# EasyEDA Pro project 第十五届蓝桥杯EDA赛项模拟试题二（嘉立创EDA提供）.eprj, board PCB-PockerMultimater1 (continued)
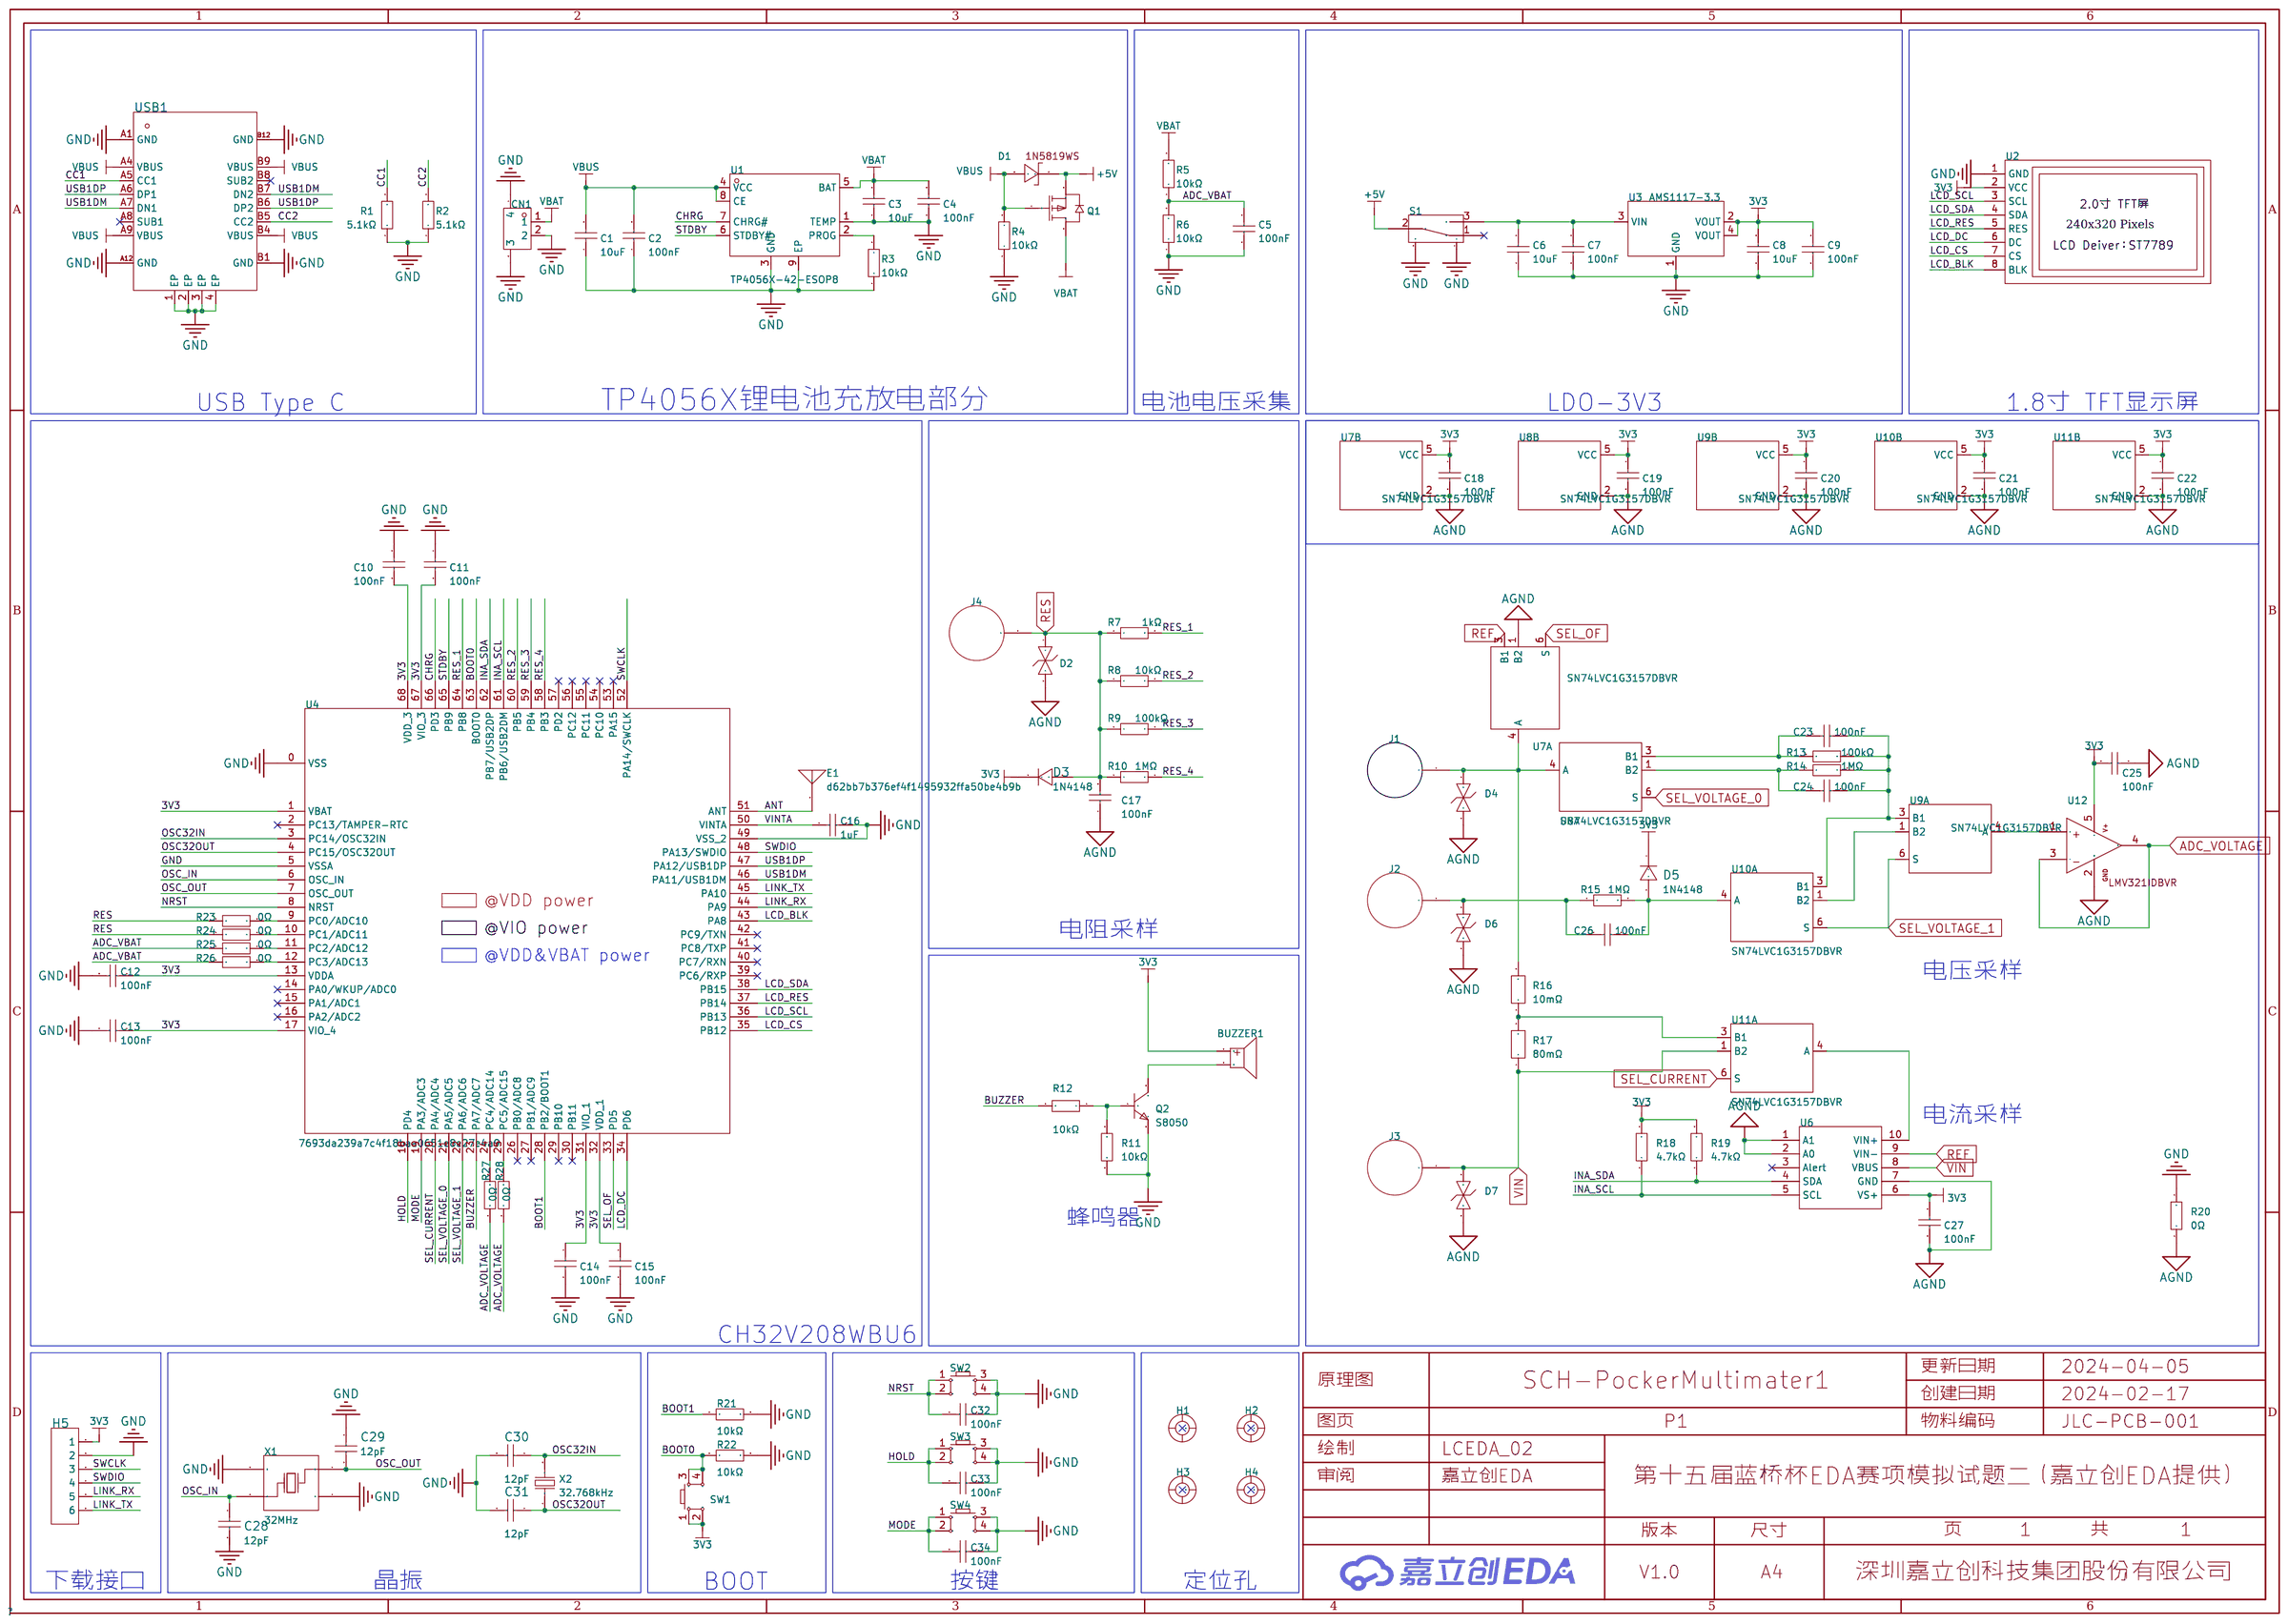
[diagram p0: schematic sheet]
## Routing (per net, layer and track width the routed paths; a pad name or vN(x,y) marks a point on that pad's centre or on a via; arc(x,y) is an arc through that point) (continued)
  Top Layer w0.61: C34.1 v1(60.96,36.6) ; R1.1 11.43,20.2 v1(11.43,18.41) 11.43,17.28 R2.1 ; v1(64.52,23.37) 64.52,24.01 Q2.2 ; C33.1 v1(61.34,45.76) ; 59.88,54.97 v1(60.96,54.97) ; C8.1 v1(18.02,43.6) 19.18,43.6 C9.2 19.26,43.69 v1(21.04,43.69) R20.2 ; C13.2 26.47,73.48 v1(26.21,73.73) ; C5.2 v1(9.27,37.54) ; R11.2 v1(59.44,26.01) ; v1(19.92,97.43) 19.92,96.11 19.91,96.1 ; 13.51,35.42 v1(13.51,37.08) ; 10.08,53.21 v1(8.87,53.21) 7.72,53.21 ; C2.1 v1(15.09,27.83) ; 44.86,78.77 v1(46.23,78.77) ; C1.1 v1(15.11,25.8) ; C12.2 v1(27.29,70.61) ; R4.1 v1(16,22.64) ; 15.59,32.12 14.96,31.49 14.96,29.75 15.11,29.59 17.42,29.59 17.43,29.58 17.45,29.59 v1(19.55,29.59) v1(20.32,29.59) 20.51,29.78 R3.1 20.45,30.93 20.45,32 v1(20.33,32.12) v1(19.55,32.12) 15.59,32.12
  Top Layer w1.143: U3.1 v1(14.72,45.59)
  vias: v1(1.74,33.53) v1(1.72,32.68) v1(1.72,31.48) v1(2.58,33.53) v1(2.55,32.68) v1(2.55,31.48) v1(10.72,88.58) v1(10.72,87.69) v1(10.72,86.92) v1(10.72,86.03) v1(10.72,85.01) v1(10.72,84.12) v1(10.72,82.27) v1(10.72,81.38) v1(10.72,79.44) v1(10.72,78.55) v1(10.71,76.16) v1(10.71,75.27) v1(12.18,64.25) v1(12.18,63.36) v1(12.38,61.54) v1(13.27,61.54) v1(13.97,74.9) v1(13.96,74.17) v1(14.73,46.23) v1(14.86,74.9) v1(14.85,74.17) v1(15.04,61.55) v1(15.93,61.55) v1(16.19,74.91) v1(16.18,74.18) v1(17.08,74.91) v1(17.07,74.18) v1(18.16,82.3) v1(18.31,61.6) v1(18.49,74.91) v1(18.48,74.18) v1(19.2,61.6) v1(19.38,74.91) v1(19.37,74.18) v1(20.57,85.32) v1(20.95,61.6) v1(21.84,61.6) v1(24.12,79.42) v1(24.24,76.2) v1(25.28,61.52) v1(26.17,61.52) v1(27.05,61.52) v1(27.94,61.52) v1(29.9,85.32) v1(29.89,84.66) v1(30.67,85.31) v1(30.68,84.66) v1(31.54,85.31) v1(31.54,84.66) v1(35.94,55.21) v1(35.94,54.32) v1(35.96,52.84) v1(35.96,51.95) v1(35.96,50.54) v1(35.96,49.65) v1(35.97,48.02) v1(35.97,47.13) v1(38.1,93.92) v1(38.1,93.03) v1(38.16,91.38) v1(38.16,90.49) v1(38.23,89.34) v1(38.23,88.46) v1(38.23,87.31) v1(38.23,86.42) v1(38.23,85.15) v1(38.23,84.26) v1(38.48,95.69) v1(38.48,94.81) v1(39.04,65.51) v1(39.06,64.94) v1(39.58,55.91) v1(39.58,55.02) v1(39.57,53.29) v1(39.57,52.4) v1(39.59,50.39) v1(39.59,49.5) v1(39.59,47.34) v1(39.59,46.45) v1(40.45,71.82) v1(40.45,70.93) v1(40.45,70.29) v1(40.45,69.41) v1(40.39,55.92) v1(40.39,55.03) v1(40.38,53.3) v1(40.38,52.41) v1(40.41,50.4) v1(40.41,49.51) v1(40.41,47.35) v1(40.41,46.46) v1(40.93,75.44) v1(40.93,74.56) v1(41.34,71.82) v1(41.34,70.93) v1(41.34,70.29) v1(41.34,69.41) v1(41.4,81.41) v1(41.82,75.44) v1(41.82,74.56) v1(42.32,57.39) v1(42.32,56.5) v1(42.32,54.28) v1(42.32,53.39) v1(42.31,51.97) v1(42.31,51.08) v1(42.33,49.65) v1(42.33,48.76) v1(42.29,47.32) v1(42.29,46.43) v1(43.12,71.82) v1(43.12,70.93) v1(43.12,70.29) v1(43.12,69.41) v1(43.13,57.4) v1(43.13,56.52) v1(43.13,54.29) v1(43.13,53.4) v1(43.12,51.98) v1(43.12,51.09) v1(43.14,49.66) v1(43.14,48.77) v1(43.1,47.33) v1(43.1,46.44) v1(43.6,75.44) v1(43.6,74.56) v1(43.81,81.92) v1(44.01,71.82) v1(44.01,70.93) v1(44.01,70.29) v1(44.01,69.41) v1(44.26,55.83) v1(44.26,54.94) v1(44.26,52.86) v1(44.26,51.97) v1(44.26,50.36) v1(44.26,49.47) v1(44.27,47.75) v1(44.27,46.86) v1(44.49,75.44) v1(44.49,74.56) v1(46.42,46.74) v1(46.42,45.85) v1(46.54,55.81) v1(46.54,54.92) v1(46.52,52.13) v1(46.52,51.24) v1(46.47,49.3) v1(46.47,48.42) v1(46.56,58.45) v1(46.56,57.56) v1(46.89,75.44) v1(46.89,74.56) v1(47.23,46.75) v1(47.23,45.86) v1(47.35,55.82) v1(47.35,54.93) v1(47.33,52.14) v1(47.33,51.25) v1(47.28,49.31) v1(47.28,48.43) v1(47.37,58.46) v1(47.37,57.57) v1(47.62,87.63) v1(47.65,82.48) v1(47.65,81.58) v1(47.73,78.18) v1(47.73,77.28) v1(47.73,53.54) v1(47.78,75.44) v1(47.78,74.56) v1(47.87,56.79) v1(47.87,50.19) v1(47.88,47.56) v1(48.13,86.36) v1(48.45,82.48) v1(48.45,81.58) v1(48.53,78.18) v1(48.53,77.28) v1(48.62,53.54) v1(48.76,56.79) v1(48.76,50.19) v1(48.77,47.56) v1(48.9,87.12) v1(49.25,58.47) v1(49.25,57.58) v1(49.19,55.82) v1(49.19,54.93) v1(49.25,52.25) v1(49.25,51.36) v1(49.3,49.21) v1(49.3,48.32) v1(49.35,46.77) v1(49.35,45.88) v1(50,55.83) v1(50,54.94) v1(50.06,58.48) v1(50.06,57.59) v1(50.06,52.26) v1(50.06,51.37) v1(50.11,49.22) v1(50.11,48.33) v1(50.16,46.78) v1(50.16,45.89) v1(50.48,84.8) v1(50.48,83.9) v1(51.28,84.8) v1(51.28,83.9) v1(51.3,79.27) v1(51.3,78.36) v1(51.56,89.79) v1(52.1,79.27) v1(52.1,78.36) v1(52.95,87.75) v1(52.95,86.85) v1(52.9,59.08) v1(52.9,58.19) v1(52.92,55.99) v1(52.92,55.1) v1(52.9,53.03) v1(52.9,52.15) v1(52.89,49.79) v1(52.89,48.9) v1(52.87,47.03) v1(52.87,46.14) v1(53.75,87.75) v1(53.75,86.85) v1(53.71,59.09) v1(53.71,58.2) v1(53.73,56) v1(53.73,55.11) v1(53.71,53.05) v1(53.71,52.16) v1(53.7,49.8) v1(53.7,48.91) v1(53.68,47.04) v1(53.68,46.16) v1(54.55,71.06) v1(54.55,70.17) v1(55.12,89.8) v1(55.12,88.9) v1(55.1,81.92) v1(55.1,81.02) v1(55.41,85.16) v1(55.41,84.26) v1(55.44,71.06) v1(55.44,70.17) v1(55.92,89.8) v1(55.92,88.9) v1(55.9,81.92) v1(55.9,81.02) v1(56.21,85.16) v1(56.21,84.26) v1(57.4,71.88) v1(57.4,70.99) v1(57.47,70.29) v1(57.47,69.41) v1(57.84,22.29) v1(57.87,23.08) v1(57.88,20.8) v1(57.85,20) v1(58.19,75.44) v1(58.19,74.56) v1(58.29,71.88) v1(58.29,70.99) v1(58.36,70.29) v1(58.36,69.41) v1(58.62,23.08) v1(58.63,22.29) v1(58.63,20.8) v1(58.64,20) v1(58.7,85.38) v1(58.7,84.48) v1(58.84,90.02) v1(58.84,89.12) v1(59.08,75.44) v1(59.08,74.56) v1(59.37,71.95) v1(59.37,71.06) v1(59.37,70.29) v1(59.37,69.41) v1(59.5,85.38) v1(59.5,84.48) v1(59.64,90.02) v1(59.64,89.12) v1(60.1,75.44) v1(60.1,74.56) v1(60.26,71.95) v1(60.26,71.06) v1(60.26,70.29) v1(60.26,69.41) v1(60.99,75.44) v1(60.99,74.56) v1(61.47,48.89) v1(61.47,47.94) v1(61.72,39.62) v1(61.72,38.86) v1(62.42,48.89) v1(62.42,47.94) v1(62.64,39.62) v1(62.64,38.86) v1(63.25,30.59) v1(63.25,29.67) v1(63.45,48.89) v1(63.45,47.94) v1(63.63,39.62) v1(63.63,38.86) v1(64.01,30.59) v1(64.01,29.67) v1(64.8,30.59) v1(64.8,29.67)
VBAT:
  vias: v1(15.75,35.81) v1(15.72,34.8) v1(16.57,35.81) v1(16.59,34.8) v1(16.89,27.94) v1(17.27,27.31) v1(17.61,35.81) v1(17.64,34.8) v1(17.65,27.94) v1(18.07,27.31) v1(18.67,27.94)
VBUS: length 24.3
  Top Layer w0.61: 17.43,33.39 20.85,33.39 21.46,32.78 21.46,29.36 20.85,28.75 12.01,28.75 ; 7.5,21.41 7.52,21.44 9.06,21.44 9.4,21.78 9.4,23.37 10.11,24.08 D1.2
VIN: length 14.4
  Top Layer w0.305: U6.8 43.89,28.37 v1(43.94,28.32)
  Top Layer w0.61: v1(43.94,23.37) 40.77,23.37 40.51,23.11 40.51,19.72 41.1,19.13
  Bottom Layer w0.61: v1(43.94,28.32) v1(43.94,23.37)
VINTA: length 4.4
  Top Layer w0.203: U4.50 43.31,78.8 C16.1
ADC_VBAT: length 67.5
  Top Layer w0.305: R26.1 22.76,71.12 v1(16.38,71.12) ; C5.1 12.03,40.04 11.94,40.13 1.4,40.13 0.76,40.77 0.76,70.74 1.14,71.12 v1(7.37,71.12)
  Top Layer w0.61: R25.1 R26.1
  Bottom Layer w0.305: v1(16.38,71.12) v1(7.37,71.12)
ADC_VOLTAGE: length 25.1
  Top Layer w0.152: v1(34.93,64.01) 34.57,64.36 33.59,64.36 33.27,64.67 33.27,65.45 R28.1 ; 34.86,42.96 v1(34.86,56.64)
  Top Layer w0.635: R27.1 33.2,65.48 R28.1
  Bottom Layer w0.152: v1(34.86,56.64) 34.93,56.71 v1(34.93,64.01)
ANT: length 24.9
  Top Layer w0.152: U4.51 40.16,79.2 53.03,92.08 57.28,92.08 57.51,92.3 57.51,93.19 57.53,93.22
BOOT0: length 27.4
  Top Layer w0.152: v1(33.53,90.93) 33.8,90.66 U4.63 ; v1(33.53,93.73) 19.94,93.73
  Bottom Layer w0.152: v1(33.53,90.93) v1(33.53,93.73)
BOOT1: length 6.1
  Top Layer w0.152: 34.65,66.72 34.67,66.74 34.67,67.69 35.05,68.07 35.69,68.07 35.8,68.19 U4.28
BUZZER: length 78.7
  Top Layer w0.152: 33.81,71.87 33.81,68.99 33.66,68.83 31.37,68.83 31.37,64.39 31.69,64.07 33.47,64.07 v1(33.91,63.64) ; v1(33.78,61.09) 54.36,61.09 54.74,60.71 54.74,35.81 54.99,35.56 56.26,35.56 56.77,35.05 56.77,24.46 57.05,24.18 R12.2
  Bottom Layer w0.152: v1(33.91,63.64) 33.91,61.21 v1(33.78,61.09)
CC1: length 2.5
  Top Layer w0.203: R1.2 9.96,20.25 USB1.A5
CC2: length 2.4
  Top Layer w0.203: USB1.B5 9.89,17.25 R2.2
CHRG: length 92.9
  Top Layer w0.152: U4.66 32.6,89.7 32.26,90.04 11.72,90.04 11.59,89.92 11.59,67.06 11.72,66.93 v1(12.45,66.93)
  Top Layer w0.61: 12.48,30.85 12.47,30.86 v1(11.25,30.86)
  Bottom Layer w0.305: v1(11.25,30.86) 11.25,33.71 11.26,33.72 11.26,65.36 11.43,65.53 12.19,65.53 12.45,65.79 v1(12.45,66.93)
HOLD: length 57.6
  Top Layer w0.152: v1(32.38,62.1) 54.86,62.1 55.88,61.09 55.88,46.1 56.22,45.76 C33.2 ; U4.18 31.8,70.79 31.75,70.74 29.11,70.74 28.96,70.59 28.96,63.25 29.08,63.12 v1(32.38,63.12)
  Bottom Layer w0.152: v1(32.38,62.1) v1(32.38,63.12)
INA_SCL: length 137.8
  Top Layer w0.152: U4.61 34.6,91.51 34.16,91.95 9.68,91.95 9.48,91.75 9.48,61.9 10.8,60.58 29.72,60.58 v1(29.84,60.71) ; R18.1 48,29.37 U6.5 45.41,29.37 45.32,29.46 45.32,58.14 44.91,58.55 v1(29.84,58.55)
  Bottom Layer w0.152: v1(29.84,58.55) v1(29.84,60.71)
INA_SDA: length 136.7
  Top Layer w0.152: v1(29.08,61.09) 28.96,60.96 11.18,60.96 9.84,62.29 9.84,91.35 10.06,91.57 33.66,91.57 34.2,91.02 U4.62 ; 28.96,58.17 v1(29.08,58.04) 44.7,58.04 44.96,57.78 44.96,29 45.09,28.87 U6.4 47.79,28.87 R19.1
  Bottom Layer w0.152: v1(29.08,58.04) v1(29.08,61.09)
LCD_BLK: length 47.5
  Top Layer w0.152: U4.43 62.54,76 62.99,76.45 62.99,79.76 63.25,80.01 66.68,80.01 67.06,79.63 67.06,66.55 66.68,66.17 64.66,66.17 64.6,66.11
LCD_CS: length 29.3
  Top Layer w0.152: U4.35 62.46,72.8 62.87,72.39 62.87,68.96 63.12,68.71 64.54,68.71 64.6,68.65
LCD_DC: length 37.2
  Top Layer w0.152: 64.6,71.19 64.66,71.25 66.04,71.25 66.29,70.99 66.29,67.44 66.17,67.31 63.88,67.31 62.36,68.83 38.35,68.83 38.2,68.99 U4.34
LCD_RES: length 26.3
  Top Layer w0.152: U4.37 65.27,73.6
LCD_SCL: length 35.2
  Top Layer w0.152: 39.01,73.2 62.74,73.2 62.75,73.2 63.32,73.2 64.01,72.52 66.04,72.52 66.29,72.77 66.29,78.49 66.04,78.74 64.67,78.74 64.6,78.81
LCD_SDA: length 27.1
  Top Layer w0.152: 64.03,76.27 64.02,76.27 63.49,76.27 63.31,76.09 63.31,74.17 63.15,74 U4.38
LINK_RX: length 33.2
  Top Layer w0.152: U4.44 39.02,76.36 43.47,76.36 v1(43.69,76.58) ; 37.72,98.04 36.83,97.16 v1(36.83,82.3)
  Bottom Layer w0.152: v1(43.69,76.58) 43.43,76.33 37.97,76.33 36.83,77.47 v1(36.83,82.3)
LINK_TX: length 32.5
  Top Layer w0.152: v1(43.05,77.09) 42.76,76.8 U4.45 ; 40.26,98.04 40.26,96.9 40.13,96.77 38.48,96.77 37.57,95.86 v1(37.57,81.76)
  Bottom Layer w0.152: v1(37.57,81.76) 37.57,77.88 38.61,76.83 42.8,76.83 v1(43.05,77.09)
MODE: length 66.2
  Top Layer w0.152: v1(33.02,61.59) 54.48,61.59 55.25,60.83 55.25,37.08 55.73,36.6 C34.2 ; U4.19 32.2,70.55 32,70.36 29.62,70.36 29.34,70.08 29.34,63.8 29.49,63.64 32.96,63.64 v1(33.04,63.56)
  Bottom Layer w0.152: v1(33.04,63.56) 33.02,63.53 v1(33.02,61.59)
NRST: length 85.1
  Top Layer w0.152: U4.8 25.6,76.4 24.64,75.44 12.19,75.44 11.97,75.22 11.97,67.56 12.1,67.44 12.7,67.44 12.95,67.18 12.95,62.76 13.11,62.61 55.5,62.61 56.64,61.47 56.64,55.25 56.96,54.93 C32.2
OSC32IN: length 25.2
  Top Layer w0.152: U4.3 23.8,78.4 23.6,78.61 23.6,86.82 23.55,86.87 19.46,86.87 19.38,86.95 C30.1
  Top Layer w0.203: X2.2 C30.1
OSC32OUT: length 25.3
  Top Layer w0.152: C31.1 19.46,86.44 19.53,86.51 23.11,86.51 23.24,86.39 23.24,78.46 23.7,78 U4.4
  Top Layer w0.203: C31.1 15.02,85.32 X2.1
OSC_IN: length 22.4
  Top Layer w0.152: X1.3 13.98,81.55 14.22,81.79 17.78,81.79 18.03,81.53 18.03,80.64 18.29,80.39 19.41,80.39 C28.1 19.43,79.5 19.53,79.39 20.78,79.39 20.93,79.24 20.93,77.34 21.08,77.2 U4.6
OSC_OUT: length 22.2
  Top Layer w0.152: U4.7 20.75,76.8 20.63,76.93 20.63,78.87 20.47,79.03 19.49,79.03 19.43,78.97 C29.2 17.33,78.17 17.14,78.36 17.14,78.97 16.99,79.12 15.09,79.12 14.86,78.89 14.86,77.72 14.99,77.6 15.12,77.6 X1.1
REF: length 38.1
  Top Layer w0.305: U6.9 40.7,27.87 40.39,27.56 40.39,26.8 v1(35.05,26.8) ; v1(22.22,21.21) 22.22,26.16 22.35,26.29 23.88,26.29 24.09,26.07 24.09,25.18
  Bottom Layer w0.305: v1(22.22,21.21) 22.22,19.43 22.48,19.18 34.8,19.18 35.05,19.43 v1(35.05,26.8)
RES: length 100.1
  Top Layer w0.152: R24.1 22.74,73.66 v1(12.83,73.66) ; C17.2 55.31,34.86 55.12,35.05 54.61,35.05 54.36,35.31 54.36,60.33 54.1,60.58 32,60.58 30.35,62.23 10.92,62.23 10.54,62.61 10.54,66.42 10.9,66.78 10.9,73.53 10.77,73.66 v1(10.72,73.66)
  Top Layer w0.61: R23.1 R24.1
  Bottom Layer w0.152: v1(10.72,73.66) v1(12.83,73.66)
RES_1: length 142.7
  Top Layer w0.152: U4.64 33.4,90.3 32.89,90.81 10.82,90.81 10.2,90.19 10.2,67.21 v1(10.36,67.06) ; v1(9.65,60.96) 9.65,60.58 10.03,60.2 52.12,60.2 52.27,60.05 52.27,26.22 52.5,25.98 R7.2
  Bottom Layer w0.152: v1(9.65,60.96) 9.53,61.09 9.53,66.93 9.65,67.06 v1(10.36,67.06)
RES_2: length 150.6
  Top Layer w0.152: U4.60 35,92 34.67,92.33 9.27,92.33 9.14,92.2 9.14,60.07 9.4,59.82 51.79,59.82 51.94,59.66 51.94,24.1 52.1,23.94 R8.2
RES_3: length 154
  Top Layer w0.152: U4.59 35.4,92.49 35.18,92.71 8.89,92.71 8.72,92.54 8.72,59.73 9.02,59.44 51.47,59.44 51.62,59.28 51.62,23.18 52.9,21.9 R9.2
RES_4: length 157.1
  Top Layer w0.152: U4.58 35.8,92.72 35.43,93.09 8.51,93.09 8.34,92.92 8.34,59.48 8.76,59.06 51.16,59.06 51.31,58.9 51.31,22.86 53.81,20.36 R10.2
SEL_CURRENT: length 72.4
  Top Layer w0.152: v1(29.84,64.21) 29.84,69.82 30,69.98 32.26,69.98 32.6,70.32 U4.20
  Top Layer w0.305: 47.54,21.1 46.75,21.1 46.61,20.96 46.61,19.94 46.48,19.81 43.81,19.81 42.93,20.7 42.93,22.22 42.67,22.48 v1(41.28,22.48) ; v1(30.48,57.28) 40.89,57.28 41.28,56.9 v1(41.28,39.62)
  Bottom Layer w0.152: v1(29.84,64.21) 30.15,64.21 30.48,63.88 v1(30.48,57.28)
  Bottom Layer w0.305: v1(41.28,22.48) v1(41.28,39.62)
SEL_OF: length 63.8
  Top Layer w0.152: v1(34.42,63.12) 38.99,63.12 39.62,63.75 39.62,68.11 39.28,68.45 37.95,68.45 37.8,68.61 U4.33
  Top Layer w0.229: v1(34.04,56.64) 34.04,41.78 33.66,41.4 27.69,41.4 v1(27.56,41.28)
  Top Layer w0.305: U7.6 26.12,22.61 v1(27.56,22.61)
  Bottom Layer w0.152: v1(34.42,63.12) 34.42,56.9 34.16,56.64 v1(34.04,56.64)
  Bottom Layer w0.305: v1(27.56,22.61) v1(27.56,41.28)
SEL_VOLTAGE_0: length 80
  Top Layer w0.152: U4.21 33,70.08 32.51,69.6 30.38,69.6 30.24,69.45 30.24,67.51 v1(30.36,67.38)
  Top Layer w0.305: v1(21.08,18.67) 21.08,27.43 21.46,27.81 23.11,27.81 23.5,28.19 v1(23.5,41.15) ; v1(23.5,58.42) v1(23.5,45.72) ; U8.6 30.95,21.63 31.12,21.46 31.12,18.03 30.86,17.78 24.26,17.78 24.13,17.91 v1(24,17.91) ; v1(23.5,67.44) v1(23.5,63.25)
  Bottom Layer w0.152: v1(30.36,67.38) 23.55,67.38 v1(23.5,67.44)
  Bottom Layer w0.305: v1(23.5,63.25) v1(23.5,58.42) ; v1(24,17.91) 21.34,17.91 21.08,18.16 v1(21.08,18.67) ; v1(23.5,45.72) v1(23.5,41.15)
SEL_VOLTAGE_1: length 57.9
  Top Layer w0.152: U4.22 33.4,69.47 33.15,69.22 30.69,69.22 30.54,69.06 30.54,68.25 ; 30.54,68.25 30.54,68.2 30.91,67.83 30.91,66.53 v1(30.84,66.46) ; 30.54,68.25 30.55,68.26
  Top Layer w0.305: v1(24.13,40.64) 24.13,34.42 24.38,34.16 28.45,34.16 ; v1(24.13,66.42) v1(24.13,64.01) ; v1(24.13,57.78) v1(24.13,46.36)
  Top Layer w0.406: U9.6 28.21,34.4 28.45,34.16 32.38,34.16 32.51,34.29 32.51,35.27 U10.6
  Bottom Layer w0.305: v1(30.84,66.46) 24.17,66.46 v1(24.13,66.42) ; v1(24.13,64.01) v1(24.13,57.78) ; v1(24.13,46.36) v1(24.13,40.64)
STDBY: length 93.2
  Top Layer w0.152: v1(11.68,66.17) 11.36,66.17 11.23,66.29 11.23,90.27 11.38,90.42 32.51,90.42 33,89.94 U4.65
  Top Layer w0.61: v1(10.67,32.11) 12.48,32.11 12.48,32.12
  Bottom Layer w0.305: v1(11.68,66.17) 10.8,66.17 10.67,66.04 v1(10.67,32.11)
SWCLK: length 23.1
  Top Layer w0.152: 32.64,98.04 32.64,96.9 32.89,96.65 35.94,96.65 36.23,96.35 36.23,81.28 36.36,81.15 38.1,81.15 38.2,81.05 U4.52
SWDIO: length 34.7
  Top Layer w0.152: v1(40.84,78.25) 40.6,78 U4.48 ; v1(39.02,81.01) 39.02,96.37 38.99,96.39 41.4,96.39 41.53,96.52 41.53,99.06 41.28,99.31 35.31,99.31 35.18,99.19 35.18,98.04
  Bottom Layer w0.152: v1(40.84,78.25) 39.14,78.25 39.02,78.37 v1(39.02,81.01)
USB1DM: length 122.6
  Top Layer w0.152: 7.2,19.75 7.19,19.73 6.69,19.73 6.6,19.82 6.6,20.49 6.52,20.57 v1(5.97,20.57) ; v1(42.29,77.6) 41.66,77.6 41.26,77.2 U4.46
  Top Layer w0.203: USB1.B7 8.88,19.75 8.94,19.69 8.94,18.77 8.92,18.75 7.5,18.75 7.48,18.75 7.5,18.75 USB1.A7
  Bottom Layer w0.152: v1(5.97,20.57) 5.61,20.57 5.38,20.34 5.31,20.34 5.16,20.49 1.38,20.49 0.98,20.89 0.98,71.79 1.57,72.37 31.34,72.37 32.15,73.18 32.15,78.25 32.46,78.56 35.09,78.56 35.33,78.79 35.33,82.92 35.74,83.33 37.5,83.33 38.08,82.75 38.08,77.8 38.68,77.2 41.25,77.2 41.65,77.6 v1(42.29,77.6)
USB1DP: length 122.6
  Top Layer w0.152: v1(41.66,78.11) 41.15,77.6 U4.47 ; v1(6.06,19.81) 6.06,19.12 6.06,19.12
  Top Layer w0.203: USB1.A6 6.19,19.25 6.07,19.13 6.07,18.36 6.17,18.26 7.48,18.26 USB1.B6
  Bottom Layer w0.152: 38.51,78.67 38.51,82.76 37.63,83.63 35.61,83.63 35.02,83.04 35.02,78.92 34.97,78.86 32.33,78.86 31.84,78.37 31.84,73.31 31.22,72.68 30.78,72.68 30.53,72.93 29.26,72.93 29,72.68 27.74,72.68 27.44,72.97 26.21,72.97 25.92,72.68 25.49,72.68 25.23,72.93 23.96,72.93 23.71,72.68 22.44,72.68 22.18,72.93 20.91,72.93 20.66,72.68 20.23,72.68 19.97,72.93 18.7,72.93 18.45,72.68 18.02,72.68 17.76,72.93 16.49,72.93 16.24,72.68 1.45,72.68 0.68,71.91 0.68,20.76 1.26,20.18 5.03,20.18 5.18,20.04 5.38,20.04 5.61,19.81 v1(6.06,19.81) ; 38.51,78.67 38.51,78.33 ; 38.51,78.67 38.5,77.87 38.76,77.62 41.17,77.62 v1(41.66,78.11)
$1N2724: length 1.6
  Top Layer w0.61: 17.43,30.85 18.99,30.85 R3.2
$1N6482: length 8.2
  Top Layer w0.406: U9.4 30.11,36.08 30.23,36.19 v1(31.88,36.19) ; v1(31.75,38.99) 31.75,39.37 32,39.62 32.77,39.62 32.96,39.82 U12.1
  Bottom Layer w0.406: v1(31.88,36.19) 32.38,36.7 32.38,38.35 v1(31.75,38.99)
$1N6484: length 11.3
  Top Layer w0.914: R17.2 50.04,25.27 50.29,25.02 50.29,23.04
$1N6487: length 22.2
  Top Layer w0.762: 28.96,22.62 28.96,23.62 28.7,23.88 24.51,23.88 24.09,23.46 U7.4
  Top Layer w0.914: 23.75,22.48 23.37,22.48 23.11,22.22 23.11,17.65 22.99,17.53 14.86,17.53 14.42,17.09 D4.1
$1N6488: length 31
  Top Layer w0.305: C26.1 36.7,33.28 v1(36.7,27.43)
  Bottom Layer w0.305: v1(36.7,27.43) 36.7,17.65 36.07,17.03 v1(26.42,17.03) ; v1(26.42,17.03) v1(26.42,16.26) v1(26.42,15.53) v1(25.65,15.53) v1(25.65,16.26) v1(25.65,17.03) v1(26.42,17.03)
$1N6508: length 9.6
  Top Layer w0.61: U9.3 30.1,32.6 30.1,31.5 30.23,31.37 30.86,31.37 ; 30.86,31.37 34.29,31.37 34.45,31.53 U10.3 ; 30.86,31.37 31,31.23 R14.2
$1N6517: length 5.7
  Top Layer w0.406: U9.1 28.21,33.16 28.57,33.53 32.13,33.53 32.55,33.11 U10.1
$1N9045: length 9.3
  Top Layer w0.305: U6.10 42.27,27.37 44.39,27.37 44.7,27.05 v1(44.7,26.42)
  Top Layer w0.406: v1(44.7,23.37) 45.07,23 47.54,23
  Bottom Layer w0.406: v1(44.7,26.42) v1(44.7,23.37)
$1N10212: length 7.8
  Top Layer w0.152: R23.2 24.64,74.8 25.84,76 U4.9
$1N10257: length 8.7
  Top Layer w0.152: 23.61,73.66 24.89,73.66 25.07,73.84 25.07,74.6 26.07,75.6 U4.10
$1N10302: length 9.6
  Top Layer w0.152: U4.11 26.18,75.2 25.37,74.4 25.37,72.49 25.27,72.39 23.68,72.39 R25.2
$1N10388: length 10.5
  Top Layer w0.152: U4.12 26.29,74.8 25.68,74.19 25.68,71.4 25.4,71.12 23.72,71.12 R26.2
$1N10482: length 7.6
  Top Layer w0.152: R27.2 32,66.37 32,68.17 32.16,68.33 33.96,68.33 34.2,68.57 U4.24
$1N10485: length 6.8
  Top Layer w0.152: U4.25 34.6,68.13 34.42,67.94 33.4,67.94 33.22,67.77 R28.2
$1N25880: length 3.7
  Top Layer w1.016: U3.3 10.08,48.19 C6.2

## Copper pours and planes (outline as drawn; the poured copper is in the pictures)
3V3 on Top Layer: 60.07,22.86 63.37,22.86 63.37,15.49 60.07,15.49
3V3 on Top Layer: 58.17,82.55 66.04,82.55 66.04,80.26 58.17,80.26
3V3 on Top Layer: 29.27,23.24 30.73,23.24 30.73,19.69 29.27,19.69
3V3 on Top Layer: 35.56,68.2 39.12,68.2 39.12,65.95 35.56,65.95
3V3 on Top Layer: 49.4,32.51 51.05,32.51 51.05,26.54 49.4,26.54
3V3 on Top Layer: 52.5,29.57 54.6,29.57 54.6,26.65 52.5,26.65
3V3 on Top Layer: 28.19,37.97 37.34,37.97 37.34,34.42 28.19,34.42
3V3 on Top Layer: 19.81,43.43 33.53,43.43 33.53,41.66 19.81,41.66
3V3 on Top Layer: 26.67,82.8 32.26,82.8 32.26,81.15 26.67,81.15
3V3 on Top Layer: 41.28,31.88 43.18,31.88 43.18,29.17 41.28,29.17
3V3 on Top Layer: 24.31,21.26 29.56,21.26 29.56,19.69 24.31,19.69
3V3 on Top Layer: 42.67,34.8 44.45,34.8 44.45,31.37 42.67,31.37
3V3 on Top Layer: 10.16,49.78 20.32,49.78 20.32,40.89 10.16,40.89
3V3 on Top Layer: 24.31,23.24 25.91,23.24 25.91,19.81 24.31,19.81
3V3 on Top Layer: 44.84,22.62 48.39,22.62 48.39,21.46 44.84,21.46
3V3 on Top Layer: 48.26,24.15 49.53,24.15 49.53,21.59 48.26,21.59
3V3 on Top Layer: 7.37,99.57 28.87,99.57 28.87,96.65 7.37,96.65
3V3 on Bottom Layer: 42.67,34.67 51.18,34.67 51.18,30.61 42.67,30.61
3V3 on Bottom Layer: 35.88,82.55 61.59,82.55 61.59,65.95 35.88,65.95
3V3 on Bottom Layer: 26.54,38.35 32.97,38.35 32.97,19.69 26.54,19.69
3V3 on Bottom Layer: 49.4,32.51 54.61,32.51 54.61,26.54 49.4,26.54
3V3 on Bottom Layer: 23.88,99.57 29.08,99.57 29.08,81.15 23.88,81.15
3V3 on Bottom Layer: 26.92,67.61 38.61,67.61 38.61,41.78 26.92,41.78
3V3 on Bottom Layer: 49.4,29.59 63.37,29.59 63.37,20.19 49.4,20.19
3V3 on Bottom Layer: 48.26,27.56 51.05,27.56 51.05,22.05 48.26,22.05
3V3 on Bottom Layer: 35.88,68.19 38.61,68.19 38.61,66.67 35.88,66.67
+5V on Top Layer: 14.22,21.34 16.89,21.34 16.89,19.05 14.22,19.05
+5V on Top Layer: 2.03,50.42 8.64,50.42 8.64,46.74 2.03,46.74
+5V on Bottom Layer: 2.16,50.29 16.89,50.29 16.89,19.05 2.16,19.05
AGND on Top Layer: 45.44,28.07 47.5,28.07 47.5,26.42 45.44,26.42
AGND on Top Layer: 24.13,44.66 54.78,44.66 56.39,43.05 56.39,18.92 57.4,17.91 59.56,17.91 59.82,17.65 59.82,15.24 60.71,14.35 62.1,14.35 70.61,5.84 70.61,-1.4 68.45,-3.56 0.89,-3.56 -1.27,-1.4 -1.27,4.06 8.38,13.72 11.56,13.72 12.32,14.48 12.32,18.54 12.7,18.92 19.05,18.92 19.43,19.3 19.43,27.81 19.69,28.07 21.84,28.07 22.1,28.32 22.1,41.28 22.48,41.66 23.75,41.66 23.88,41.78 23.88,44.4
AGND on Top Layer: 24.64,27.16 26.38,27.16 26.38,24.47 24.64,24.47
AGND on Bottom Layer: -1.27,-1.4 0.89,-3.56 68.45,-3.56 70.61,-1.4 70.61,5.84 62.1,14.35 60.71,14.35 60.71,14.6 59.82,15.49 59.82,17.02 58.93,17.91 57.4,17.91 56.39,18.92 56.39,43.04 54.74,44.69 24.33,44.69 24.13,44.48 24.13,42.04 23.81,41.72 22.54,41.72 22.1,41.28 22.1,28.32 21.84,28.07 19.69,28.07 19.43,27.81 19.43,19.3 19.05,18.92 12.7,18.92 12.32,18.54 12.32,14.48 11.43,13.59 9.14,13.59 1.4,5.84 -0.89,5.84 -1.14,5.59 -1.27,5.59
GND on Top Layer: 29.26,85.6 32.32,85.6 32.32,82.98 29.26,82.98
GND on Top Layer: 33.99,65.79 39.37,65.79 39.37,64.69 33.99,64.69
GND on Top Layer: 57.11,40.13 68.16,40.13 68.16,38.1 57.11,38.1
GND on Top Layer: 0.61,36.43 10.16,36.43 10.16,28.89 0.61,28.89
GND on Top Layer: 69.09,100.08 70.36,98.81 70.36,7.11 70.23,6.99 61.72,15.49 60.45,15.49 60.07,15.88 60.07,17.91 59.82,18.16 57.91,18.16 56.51,19.56 56.51,44.07 55.63,44.96 23.88,44.96 23.75,44.83 23.75,42.09 23.44,41.78 22.1,41.78 21.72,41.4 21.72,33.15 21.84,33.02 21.84,28.57 21.59,28.32 19.56,28.32 19.18,27.94 19.18,19.69 18.54,19.05 12.32,19.05 12.06,18.8 12.06,14.48 11.56,13.97 6.73,13.97 6.22,13.46 6.22,11.94 -1.14,4.57 -1.27,4.57 -1.27,98.17 0.64,100.08
GND on Top Layer: 57.11,30.94 68.16,30.94 68.16,28.91 57.11,28.91
GND on Top Layer: 57.15,49.28 68.2,49.28 68.2,47.24 57.15,47.24
GND on Bottom Layer: 69.09,100.24 70.36,98.97 70.36,7.28 70.23,7.15 61.72,15.66 60.45,15.66 60.07,16.04 60.07,18.07 59.82,18.32 57.91,18.32 56.51,19.72 56.51,44.23 55.63,45.12 23.88,45.12 23.75,44.99 23.75,42.26 23.44,41.95 22.1,41.95 21.72,41.56 21.72,33.31 21.84,33.18 21.84,28.74 21.59,28.48 19.56,28.48 19.18,28.1 19.18,19.85 18.54,19.21 12.32,19.21 12.06,18.96 12.06,14.64 11.56,14.13 6.73,14.13 6.22,13.62 6.22,12.1 -1.14,4.74 -1.27,4.74 -1.27,98.33 0.64,100.24
VBAT on Top Layer: 7.49,36.02 9.44,36.02 9.44,34.03 7.49,34.03
VBAT on Top Layer: 16.26,28.24 19.05,28.24 19.05,25.63 16.26,25.63
VBAT on Top Layer: 4.05,34.03 13.31,34.03 13.31,32.89 4.05,32.89
VBAT on Top Layer: 12.45,36.19 18.54,36.19 18.54,33.4 12.45,33.4
VBAT on Bottom Layer: 15.11,36.19 19.05,36.19 19.05,26.92 15.11,26.92
VBUS on Top Layer: 5,21.74 8.38,21.74 8.38,16.26 5,16.26
VBUS on Top Layer: 11.43,30.1 17.08,30.1 17.08,23.24 11.43,23.24
VIN on Top Layer: 36.07,20.07 48.39,20.07 48.39,1.65 36.07,1.65
VIN on Top Layer: 42.66,21.59 51.05,21.59 51.05,18.29 42.66,18.29
ADC_VBAT on Top Layer: 9.4,38.25 12.7,38.25 12.7,34.67 9.4,34.67
ADC_VOLTAGE on Top Layer: 34.42,43.56 35.31,43.56 35.31,39.62 34.42,39.62
BOOT0 on Top Layer: 7.24,95.35 20.7,95.35 20.7,93.47 7.24,93.47
HOLD on Top Layer: 57.28,46.48 67.94,46.48 67.94,42.67 57.28,42.67
MODE on Top Layer: 57.02,37.72 68.1,37.72 68.1,33.53 57.02,33.53
NRST on Top Layer: 57.15,55.75 68.2,55.75 68.2,51.82 57.15,51.82
RES on Top Layer: 50.29,31.37 63.12,31.37 63.12,1.27 50.29,1.27
$1N6484 on Top Layer: 34.09,26.16 43.05,26.16 43.05,24.13 34.09,24.13
$1N6487 on Top Layer: 6.73,17.02 19.43,17.02 19.43,1.4 6.73,1.4
$1N6487 on Top Layer: 27.94,23.8 38,23.8 38,18.29 27.94,18.29
$1N6488 on Top Layer: 36.19,34.04 39.62,34.04 39.62,32.89 36.19,32.89
$1N6488 on Top Layer: 20.96,17.4 33.91,17.4 33.91,1.78 20.96,1.78
$1N6489 on Top Layer: 34.06,37.97 40,37.97 40,34.22 34.06,34.22
$1N6490 on Top Layer: 30.35,27.56 33.78,27.56 33.78,24.51 30.35,24.51
$1N6491 on Top Layer: 26.29,27.56 29.97,27.56 29.97,24.51 26.29,24.51
$1N6508 on Top Layer: 26.29,29.08 33.91,29.08 33.91,27.76 26.29,27.76
$1N25880 on Top Layer: 2.03,52.7 10.8,52.7 10.8,50.8 2.03,50.8
$1N64534 on Top Layer: 65.53,25.65 68.07,25.65 68.07,15.62 65.53,15.62
$1N64552 on Top Layer: 61.87,26.8 65.56,26.8 65.56,23.37 61.87,23.37

Small or netless copper shapes (teardrops, artwork), in the pictures only: 465 on Top Layer, 81 on Bottom Layer
